# EasyEDA Pro project 定时喝水PCB.eprj, board PCB1
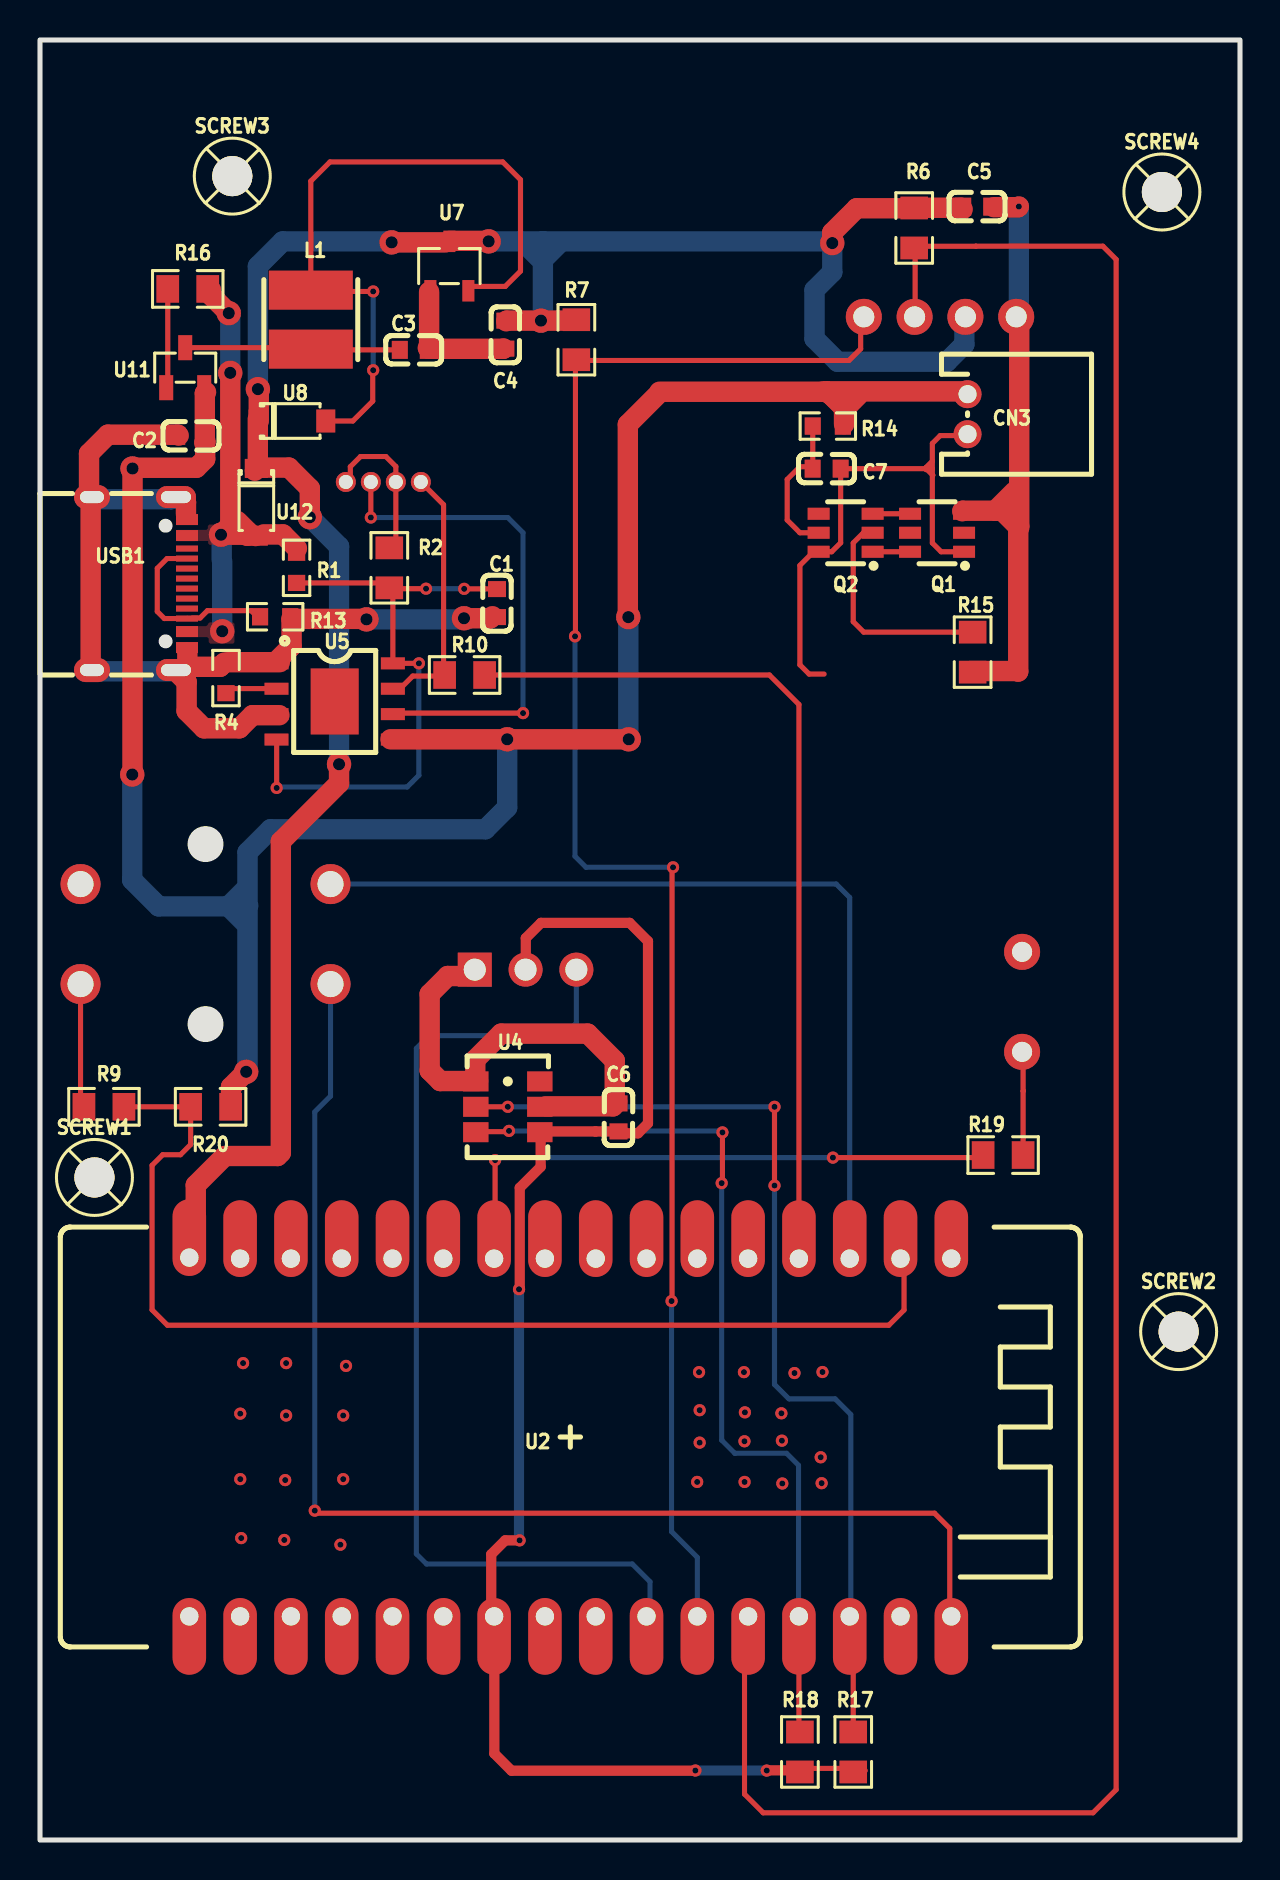
[diagram p2: board, top side]
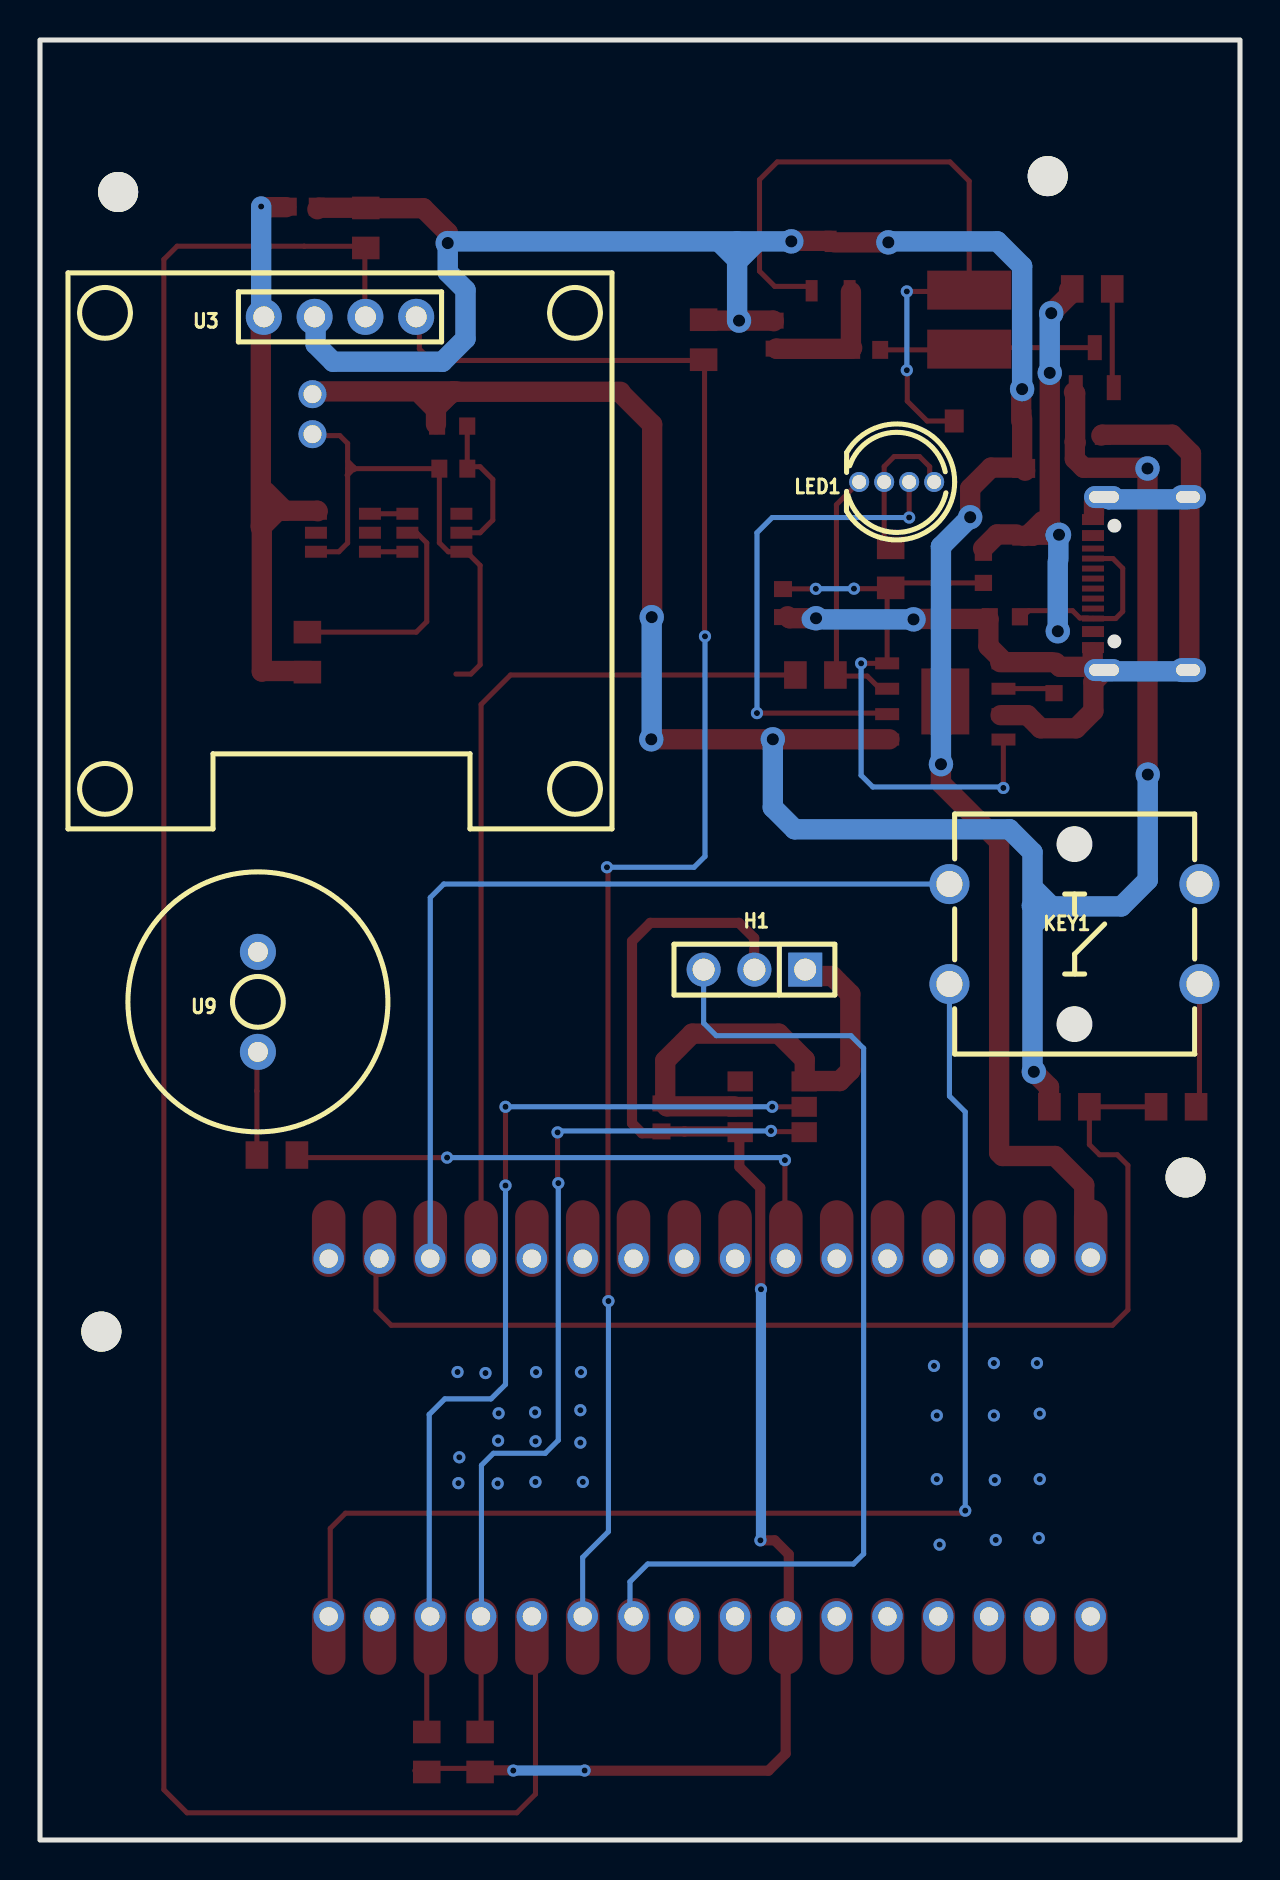
[diagram p3: board, bottom side, seen from below]

Outline 60 x 90 mm; copper layers: Top Layer, Bottom Layer. Coordinates in mm from the lower left corner of the outline.
Outline path: rectangle 0,90 60,0
Stack: Top Layer 0.035mm / Dielectric1 1.51mm FR4 er 4.5 / Bottom Layer 0.035mm

## Design rules (mm)
template: JLCPCB Capability(Two Layers Board)
spacing copperThickness1oz (default): track to track 0.102, other pairs 0.152 to 0.3
spacing copperThickness2oz: track to track 0.203, other pairs 0.152 to 0.3
track width copperThickness1oz (default): min 0.127, default 0.254, max 2.54
track width copperThickness2oz: min 0.203, default 0.254, max 2.54
differential pair differentialPair (default): width min 0.127, default 0.254, max 2.54; gap min 0.152, default 0.152
via viaSize (default): diameter min 0.5, default 0.61, max 10; hole min 0.3, default 0.305, max 6.3

## Placement (name value [footprint] x y rotation side)
C1  10uF  [C0603]  22.85 61.85 90 top
C2  10uF  [C0603]  7.56 70.2 0 top
C3  10uF  [C0603]  18.69 74.51 0 top
C4  22uF  [C0603]  23.27 75.27 90 top
C5  100nF  [C0603]  46.86 81.67 0 top
C6  100nF  [C0603]  28.92 36.13 90 top
C7  100nF  [C0603]  39.33 68.57 0 top
CN3  PH-2AWDK  [CONN-TH_PH-2AWDK]  46.38 71.29 90 top
H1  PZ254V-11-03P  [HDR-TH_3P-P2.54-V-M]  24.28 43.52 0 bottom
KEY1  B3F-4055  [KEY-TH_4P-L12.0-W12.0-P5.00-LS13.4-EH]  8.28 45.3 180 bottom
L1  47uH  [IND-SMD_L4.5-W4.0_GCD43-XX]  13.54 76.02 90 top
LED1  XL-B504RGBC  [LED-TH_4P-BD5.8-P1.25]  17.17 67.9 0 bottom
Q1  FS8205A  [SOT-23-6_L2.9-W1.6-P0.95-LS2.8-BR]  44.85 65.36 0 top
Q2  DW01  [SOT-23-6_L2.9-W1.6-P0.95-LS2.8-BR]  40.28 65.36 0 top
R1  400mΩ  [R0603]  12.83 63.61 270 top
R2  1kΩ  [R0805]  17.47 63.61 90 top
R4  1.2kΩ  [R0603]  9.3 58.1 90 top
R6  4.7kΩ  [R0805]  43.71 80.6 90 top
R7  4.7kΩ  [R0805]  26.82 75.01 90 top
R9  10kΩ  [R0805]  3.2 36.66 180 top
R10  10kΩ  [R0805]  21.23 58.25 0 top
R13  5.1kΩ  [R0603]  11.76 61.16 180 top
R14  100Ω  [R0603]  39.39 70.7 180 top
R15  1kΩ  [R0805]  46.63 59.39 90 top
R16  10kΩ  [R0805]  7.39 77.55 180 top
R17  4.7kΩ  [R0805]  40.66 4.4 270 top
R18  4.7kΩ  [R0805]  37.99 4.4 90 top
R19  1kΩ  [R0805]  48.15 34.25 0 top
R20  10kΩ  [R0805]  8.53 36.66 180 top
SCREW1  -  [M2螺丝]  2.72 33.13 0 top
SCREW2  -  [M2螺丝]  56.93 25.42 0 top
SCREW3  -  [M2螺丝]  9.61 83.19 0 top
SCREW4  -  [M2螺丝]  56.09 82.4 0 top
U2  ESP32C3-合宙  [esp32c3-合宙]  26.53 20.15 270 top
U3  HS96L03W2C03  [OLED-TH_L27.8-W27.2-P2.54_C9900033791]  45 76.16 180 bottom
U4  AHT10  [SENSOR-SMD_AHT10]  23.39 36.66 270 top
U5  TP4056  [ESOP-8_L4.9-W3.9-P1.27-LS6.0-BL-EP]  14.73 56.93 270 top
U7  QX2303L50T  [SOT-23-3_L2.9-W1.6-P1.90-LS2.8-BR]  20.47 78.7 270 top
U8  SD103AW  [SOD-123_L2.8-W1.8-LS3.7-RD]  12.6 70.95 0 top
U9  4kHz  [BUZ-TH_BD12.5-P5.00-D0.9]  49.11 41.91 270 bottom
U11  KY2301H  [SOT-23-3_L2.9-W1.3-P1.90-LS2.4]  7.26 73.62 270 top
U12  SD103AW  [SOD-123_L2.8-W1.8-LS3.7-RD]  10.82 66.89 270 top
USB1  TYPE-C 16PIN 2MD(073)  [USB-C-SMD_TYPE-C-6PIN-2MD-073]  4.97 62.82 270 top

## Footprints (pads in the part's own frame, mm; a bottom-side part is the same pattern mirrored in y, then rotated)
BUZ-TH_BD12.5-P5.00-D0.9
  round 1.8 hole 1: 1(-2.5,0) 2(2.5,0)
C0603
  rect 0.8x0.9 smd: 1(-0.7,0) 2(0.7,0)
CONN-TH_PH-2AWDK
  round 1.4 hole 0.9: 1(-1,0) 2(1,0)
ESOP-8_L4.9-W3.9-P1.27-LS6.0-BL-EP
  rect 0.6x1.2 smd: 1(-1.905,-2.909) 2(-0.635,-2.909) 3(0.635,-2.909) 4(1.905,-2.909) 5(1.905,2.909) 6(0.635,2.909) 7(-0.635,2.909) 8(-1.905,2.909)
  rect 3.3x2.4 smd: 9(0,0)
esp32c3-合宙
  oval 3.836x1.677 smd: 1(-9.918,19.038) 2(-9.918,16.498) 3(-9.918,13.958) 4(-9.918,11.418) 5(-9.918,8.878) 6(-9.918,6.338) 7(-9.918,3.798) 8(-9.918,1.258) 9(-9.918,-1.282) 10(-9.918,-3.822) 11(-9.918,-6.362) 12(-9.918,-8.902) 13(-9.918,-11.442) 14(-9.918,-13.982) 15(-9.918,-16.522) 16(-9.97,-19.062) 17(9.97,19.038) 18(9.97,16.498) 19(9.97,13.958) 20(9.97,11.418) 21(9.97,8.878) 22(9.97,6.338) 23(9.97,3.798) 24(9.97,1.258) 25(9.97,-1.282) 26(9.97,-3.822) 27(9.97,-6.35) 28(9.97,-8.902) 29(9.97,-11.442) 30(9.97,-13.982) 31(9.97,-16.522) 32(9.97,-19.062)
  round 1.524 hole 0.914: 1(-8.918,19.038) 2(-8.918,16.498) 3(-8.918,13.958) 4(-8.918,11.418) 5(-8.918,8.878) 6(-8.918,6.338) 7(-8.918,3.798) 8(-8.918,1.258) 9(-8.918,-1.282) 10(-8.918,-3.822) 11(-8.918,-6.362) 12(-8.918,-8.902) 13(-8.918,-11.442) 14(-8.918,-13.982) 15(-8.918,-16.522) 16(-8.97,-19.062) 17(8.97,19.038) 18(8.97,16.498) 19(8.97,13.958) 20(8.97,11.418) 21(8.97,8.878) 22(8.97,6.338) 23(8.97,3.798) 24(8.97,1.258) 25(8.97,-1.282) 26(8.97,-3.822) 27(8.97,-6.362) 28(8.97,-8.902) 29(8.97,-11.442) 30(8.97,-13.982) 31(8.97,-16.522) 32(8.97,-19.062)
HDR-TH_3P-P2.54-V-M
  rect 1.7x1.7 hole 1.1: 1(-2.54,0)
  round 1.7 hole 1.1: 2(0,0) 3(2.54,0)
IND-SMD_L4.5-W4.0_GCD43-XX
  rect 1.95x4.2 smd: 1(-1.475,0) 2(1.475,0)
KEY-TH_4P-L12.0-W12.0-P5.00-LS13.4-EH
  round 2 hole 1.3: 1(6.25,-2.5) 2(-6.25,-2.5) 3(6.25,2.5) 4(-6.25,2.5)
LED-TH_4P-BD5.8-P1.25
  round 1 hole 0.7: 1(0.625,0) 2(1.875,0) 3(-0.625,0) 4(-1.875,0)
M2螺丝
  round 2 hole 2: 1(0,0)
OLED-TH_L27.8-W27.2-P2.54_C9900033791
  round 1.8 hole 1.05: 1(-3.81,0) 2(-1.27,0) 3(1.27,0) 4(3.81,0)
R0603
  rect 0.806x0.864 smd: 1(-0.753,0) 2(0.753,0)
R0805
  rect 1.133x1.377 smd: 1(-1,0) 2(1,0)
SENSOR-SMD_AHT10
  rect 1x1.27 smd: 1(-1.27,-1.6) 2(0,-1.6) 3(1.27,-1.6) 4(1.27,1.6) 5(0,1.6) 6(-1.27,1.6)
SOD-123_L2.8-W1.8-LS3.7-RD
  rect 0.95x1.15 smd: 1(-1.692,0) 2(1.692,0)
SOT-23-3_L2.9-W1.3-P1.90-LS2.4
  rect 1.25x0.7 smd: 1(1,-0.95) 2(1,0.95) 3(-1,0)
SOT-23-3_L2.9-W1.6-P1.90-LS2.8-BR
  rect 1.07x0.6 smd: 1(1.235,-0.95) 2(1.235,0.95) 3(-1.235,0)
SOT-23-6_L2.9-W1.6-P0.95-LS2.8-BR
  rect 1.1x0.6 smd: 1(1.35,-0.95) 2(1.35,0) 3(1.35,0.95) 4(-1.35,0.95) 5(-1.35,0) 6(-1.35,-0.95)
USB-C-SMD_TYPE-C-6PIN-2MD-073
  rect 0.55x1.1 smd: 1(-3.2,2.375) 2(-2.4,2.375) 11(2.4,2.375) 12(3.2,2.375)
  rect 0.3x1.1 smd: 3(-1.75,2.375) 4(-1.25,2.375) 5(-0.75,2.375) 6(-0.25,2.375) 7(0.25,2.375) 8(0.75,2.375) 9(1.25,2.375) 10(1.75,2.375)
  oval 1.1x2 hole 0.6x1.5: 13(-4.325,1.825) 14(4.325,1.825)
  oval 1.2x1.8 hole 0.6x1.2: 13(-4.325,-2.375) 14(4.325,-2.375)

## Nets
As in the schematic, except:
GND: C1.1 C2.1 C3.2 C4.1 C5.2 C6.2 H1.1 Q1.3 R4.2 R13.1 R15.1 U3.1 U4.1 U4.5 U5.1 U5.3 U7.1 U9.1 USB1.1 USB1.12 USB1.13 USB1.14
AHT_SCL: R17.1 U2.19 U4.2
AHT_SDA: R18.2 U2.20 U4.3

Pads without a net: KEY1 3; Q1 2 5; Q2 4; SCREW1 1; SCREW2 1; SCREW3 1; SCREW4 1; U2 1 5 6 7 8 9 11 12 13 14 15 18 24 25 27 28 29 30 31 32; U4 6; U5 9; USB1 3 5 6 7 8 9

## Via types
v1: diameter 1.219, hole 0.61, Top Layer to Bottom Layer, 19 vias
v2: diameter 0.61, hole 0.305, Top Layer to Bottom Layer, 52 vias

## Routing (per net, layer and track width the routed paths; a pad name or vN(x,y) marks a point on that pad's centre or on a via; arc(x,y) is an arc through that point)
+3.3V: length 73.1
  Top Layer w0.254: 41.26,3.47 41.15,3.58 38.07,3.58
  Top Layer w0.508: 22.9,9.77 22.72,9.58 22.72,4.32 23.57,3.47 32.76,3.47 v2(32.77,3.47) ; 22.56,11.25 22.56,14.28 23.26,14.98 v2(23.98,14.98) ; 24.05,43.57 24.29,43.81 24.29,45.1 25.05,45.86 29.48,45.86 30.4,44.94 30.4,35.84 29.9,35.33 29.29,35.33 29.19,35.44 ; v2(23.95,27.54) 23.99,27.57 23.99,32.61 25.03,33.66 25.03,35.41 ; 25.06,35.39 25.1,35.43 27.77,35.43 ; 28.98,35.32 28.87,35.43 27.77,35.43 ; 36.37,3.47 36.36,3.48 ; 27.77,35.43 27.77,35.42 ; 36.32,3.48 38.03,3.48
  Bottom Layer w0.508: v2(36.34,3.47) 36.33,3.47 v2(32.77,3.47) ; v2(23.98,14.98) 23.95,15.01 v2(23.95,27.54)
+5V: length 22.1
  Top Layer w1.016: 9.87,65.94 10.4,65.41 10.4,65.21 ; v1(9.51,73.36) 9.51,65.72 v1(9.05,65.26) 10.29,65.26 10.34,65.21 ; 12.85,64.58 12.15,65.28 11.18,65.28 ; v1(9.11,60.44) 9.06,60.39 ; v1(9.44,76.34) 8.54,77.24 8.54,77.51 ; 10.76,65.22 10.78,65.2
  Bottom Layer w1.016: v1(9.51,73.36) 9.51,76.27 v1(9.44,76.34) ; 9.08,64.02 9.08,65.23 ; 9.08,65.23 9.21,65.23 9.21,65.28 ; 9.08,65.23 v1(9.05,65.26) ; v1(9.11,60.44) 9.11,63.92
+VCC: length 115.2
  Top Layer w1.016: 26.46,75.97 26.46,75.97 v1(25.05,75.97) 23.34,75.97 23.31,75.94 ; 10.89,71.05 10.89,68.62 ; 10.89,68.62 12.45,68.62 13.49,67.58 v1(13.49,66.14) ; 10.89,68.62 10.89,68.61 10.74,68.46 ; 43.77,81.61 46.06,81.61 46.13,81.54 ; v1(14.95,53.79) 14.95,52.84 12.04,49.93 12.04,34.37 11.87,34.2 9.24,34.2 7.79,32.74 7.79,31.12 ; v1(39.61,79.85) 39.61,80.37 40.83,81.59 43.62,81.59 ; v1(22.43,79.93) 22.41,79.96 20.49,79.96 ; v1(17.58,79.88) 20.27,79.88 ; 10.94,70.95 10.94,72.25
  Bottom Layer w1.016: 25.14,79.93 v1(22.43,79.93) ; 25.14,79.93 39.53,79.93 v1(39.61,79.85) 39.61,78.39 38.73,77.5 38.73,75.06 39.88,73.91 45.35,73.91 46.22,74.78 46.22,76.03 ; 25.14,79.93 25.14,79.01 ; v1(17.58,79.88) 17.53,79.93 12.14,79.93 10.89,78.69 v1(10.89,72.54) ; 25.14,79.01 25.91,79.77 ; 25.14,79.01 25.14,76.06 v1(25.05,75.97) ; v1(13.49,66.14) 14.95,64.68 v1(14.95,53.79) ; 24.93,79.13 24.21,79.85
GND: length 113.6
  Top Layer w1.016: 25.29,36.68 28.65,36.68 28.77,36.8 ; 48.86,66.64 48.91,66.59 48.91,65.66 ; 48.73,76.5 48.96,76.27 48.96,65.71 48.91,65.66 ; 7.36,58.66 7.21,58.51 ; 7.36,58.66 9.01,58.66 9.22,58.87 ; 7.36,58.66 7.3,58.66 ; 7.36,58.66 7.37,58.67 7.37,59.37 ; 6.93,70.22 6.89,70.27 3.39,70.27 2.45,69.32 2.45,67.4 2.36,67.31 ; 12.58,61 12.58,59.69 11.89,59 ; 21.76,37.98 21.76,39.02 23.06,40.32 27.39,40.32 28.74,38.97 28.74,37.03 28.86,36.91 ; 47.76,66.46 48.11,66.46 48.91,65.66 ; 47.76,66.46 46.14,66.46 46.11,66.44 ; 47.76,66.46 48.71,67.41 ; 11.97,56.24 10.63,56.24 9.97,55.59 8.2,55.59 7.33,56.45 7.33,57.9 6.9,58.34 ; v1(16.32,61.03) 16.3,61.05 12.57,61.05 ; 48.91,65.66 48.96,65.61 ; 48.91,65.66 48.91,58.42 48.88,58.45 46.49,58.45 ; 19.39,74.61 19.45,74.67 19.45,77.41 ; 7.3,66.29 7.3,66.88 6.99,67.19 ; 19.42,74.56 23.17,74.56 23.18,74.58 ; 2.56,58.43 2.53,58.47 2.53,67.03 2.52,67.04 ; 47.69,81.64 48.91,81.64 v2(48.94,81.67) ; 21.9,37.95 20.01,37.95 19.48,38.48 19.48,42.3 20.39,43.2 21.44,43.2 21.77,43.53 ; 9.42,58.89 11.99,58.89 ; v1(21.2,61.09) 22.52,61.09 22.62,61.19
  Bottom Layer w1.016: 21.41,61.04 21.25,61.04 v1(21.2,61.09) ; 6.85,58.47 6.82,58.43 2.56,58.43 ; 48.88,76.15 48.94,76.22 v2(48.94,81.67) ; 6.65,67.13 6.55,67.04 2.63,67.04 ; v1(16.32,61.03) 20.86,61.03
  vias: v2(10.01,21.32) v2(10.01,18.04) v2(10.06,15.09) v2(10.15,23.84) v2(12.26,18) v2(12.21,15) v2(12.31,23.84) v2(12.31,21.22) v2(15.02,14.77) v2(15.16,21.22) v2(15.16,18.04) v2(15.3,23.7) v2(32.86,17.9) v2(32.95,23.39) v2(32.98,21.49) v2(32.98,19.87) v2(35.2,23.39) v2(35.24,21.38) v2(35.22,19.94) v2(35.23,17.9) v2(37.07,21.33) v2(37.1,19.97) v2(37.12,17.83) v2(37.72,23.35) v2(39.03,19.14) v2(39.12,23.4) v2(39.08,17.84)
AHT_SCL: length 48.3
  Top Layer w0.254: v2(36.73,32.72) v2(36.73,36.66) ; R17.1 40.66,10 U2.19 ; U4.2 v2(23.39,36.66)
  Bottom Layer w0.254: v2(36.73,36.66) v2(23.39,36.66) ; 40.46,11.13 40.54,11.2 40.54,21.28 39.76,22.05 37.45,22.05 36.73,22.78 v2(36.73,32.72)
AHT_SDA: length 45.2
  Top Layer w0.254: v2(34.08,32.84) 34.12,32.88 v2(34.12,35.38) ; U2.20 37.95,5.45 R18.2 ; v2(23.45,35.45) 23.41,35.42 21.88,35.42
  Bottom Layer w0.254: v2(34.12,35.38) 34.05,35.45 v2(23.45,35.45) ; v2(34.08,32.84) 34.08,19.99 34.74,19.34 37.33,19.34 37.93,18.73 37.93,11.39
BAT+: length 116.5
  Top Layer w1.016: v1(4.61,53.27) 4.63,53.29 v1(4.63,68.58) 4.66,68.61 7.82,68.61 8.26,69.05 8.26,69.9 ; 39.26,72.41 39.39,72.41 ; 39.26,72.41 39.37,72.41 ; 39.26,72.41 30.97,72.41 ; 39.39,72.41 39.41,72.39 39.39,72.41 ; 8.26,69.9 8.24,69.92 8.24,72.33 8.3,72.39 ; 8.26,69.9 8.21,69.86 ; 8.26,69.9 8.26,69.99 ; 39.41,72.36 39.44,72.36 ; 39.44,72.36 39.91,71.92 ; 39.44,72.36 39.41,72.39 ; 39.44,72.36 39.5,72.31 ; 39.5,72.31 40.2,71.6 40.2,71.52 ; 39.5,72.31 39.46,72.31 ; 40.2,71.52 40.19,71.51 ; 40.2,71.52 40.2,70.79 ; 40.2,71.52 40.89,72.21 ; v1(10.31,38.41) 9.55,37.65 9.55,36.66 ; 29.41,61.07 29.39,61.09 29.39,70.78 30.97,72.36 ; 17.53,55.04 v1(23.36,55.04) v1(29.44,55.04) ; 46.33,72.4 46.3,72.43 39.16,72.43
  Bottom Layer w1.016: 9.42,46.68 10.28,45.82 ; 9.42,46.68 5.93,46.68 4.61,48 v1(4.61,53.27) ; 9.42,46.68 10.28,47.54 ; 9.42,46.68 10.37,46.68 ; 10.41,46.71 10.38,46.68 10.37,46.68 ; v1(29.44,55.04) 29.41,55.06 v1(29.41,61.14) ; v1(10.31,38.41) 10.37,38.47 10.37,46.68 ; v1(23.36,55.04) 23.36,51.62 22.27,50.54 11.53,50.54 10.37,49.38 10.37,46.68
CHARGING: length 13
  Top Layer w0.254: U5.7 18,57.56 18.64,58.2 20.18,58.2 ; 20.18,58.2 R10.1 ; 20.18,58.2 20.18,66.77 LED1.2
IO_BUZZ: length 5.2
  Top Layer w0.254: 49.12,39.45 49.15,39.42 49.15,37.45 ; 49.15,37.45 R19.2 ; 49.15,37.45 49.17,37.46
IO_SR602: length 50.5
  Bottom Layer w0.254: U2.23 30.5,11.36 30.5,12.91 29.61,13.8 19.33,13.8 18.82,14.31 18.82,39.58 19.45,40.22 26.18,40.22 26.82,40.85 H1.3
OLED_SCL: length 117.2
  Top Layer w0.254: 43.76,75.96 43.76,79.28 43.58,79.46 ; 44.01,79.69 46.79,79.69 46.79,79.69 53.14,79.69 53.81,79.03 53.81,2.52 52.65,1.36 36.16,1.36 35.23,2.29 35.23,9.46 35.52,9.75
OLED_SDA: length 84
  Top Layer w0.254: 31.6,48.64 31.6,27.02 31.53,26.95 ; 41.17,76.05 41.03,75.92 41.03,74.56 40.45,73.98 26.97,73.98 ; v2(26.75,60.18) 26.77,60.2 26.77,73.95
  Bottom Layer w0.254: 32.92,11 32.87,11.05 32.87,14.13 31.58,15.42 v2(31.58,26.95) ; v2(31.65,48.64) 27.3,48.64 26.75,49.18 v2(26.75,60.18)
$1N2086: length 25.3
  Top Layer w0.254: U5.6 17.7,56.34 v2(24.15,56.34) ; LED1.3 v2(16.54,66.12)
  Bottom Layer w0.254: v2(24.15,56.34) 24.15,65.36 23.39,66.12 v2(16.54,66.12)
$1N2169: length 2.5
  Top Layer w0.254: 9.3,57.57 11.82,57.57 U5.2
$1N2994: length 7.7
  Top Layer w0.254: R2.2 17.79,64.93 LED1.1 17.79,68.67 17.29,69.17 16.02,69.17 15.52,68.66 15.52,68.13 LED1.4
$1N2995: length 30.4
  Top Layer w0.254: 17.64,62.56 U5.8 v2(18.95,58.83) ; 17.64,62.56 v2(19.3,62.56) ; 17.64,62.56 17.62,62.56 17.61,62.55 ; R2.1 17.22,62.85 R1.2 ; U5.4 11.83,55.02 v2(11.83,52.6) ; v2(21.21,62.56) 22.75,62.56 22.79,62.52
  Bottom Layer w0.254: v2(11.83,52.6) 11.88,52.65 18.36,52.65 18.95,53.24 v2(18.95,58.83) ; v2(19.3,62.56) 21.2,62.56 21.21,62.56
$1N3520: length 35.7
  Top Layer w0.254: v2(16.66,73.49) 16.64,73.47 16.64,71.94 15.64,70.95 U8.2 ; v2(16.66,77.43) 13.61,77.43 L1.2 13.54,82.94 14.5,83.9 23.14,83.9 24.02,83.01 24.02,78.44 23.26,77.68 21.64,77.68 U7.2
  Bottom Layer w0.254: v2(16.66,77.43) v2(16.66,73.49)
$1N9123: length 9
  Top Layer w0.254: 7.36,61.08 USB1.10 6.22,61.07 5.86,61.42 5.86,63.58 6.35,64.07 USB1.4 ; 10.83,61.19 10.56,61.47 8.37,61.47 8.01,61.1 7.62,61.1
$1N9611: length 2
  Top Layer w0.254: 41.5,66.31 Q1.4
$1N9631: length 2
  Top Layer w0.254: Q1.6 41.5,64.41
$1N9833: length 11.3
  Top Layer w0.254: Q2.2 41.17,65.36 40.66,64.85 40.66,60.92 41.19,60.39 R15.2
$1N10240: length 5
  Top Layer w0.254: U11.1 6.39,72.69 R16.2
$1N10297: length 10.8
  Top Layer w0.254: C3.1 13.58,74.51 L1.1 13.47,74.62 U11.3
$1N10551: length 63.2
  Top Layer w0.254: v2(13.74,16.47) 13.86,16.34 44.73,16.34 45.49,15.58 45.49,11.26 45.57,11.18
  Bottom Layer w0.254: KEY1.2 14.53,37.19 13.74,36.41 v2(13.74,16.47)
$1N10631: length 56.7
  Top Layer w0.254: U2.2 43.2,29.89 43.2,26.5 42.44,25.74 6.37,25.74 5.6,26.51 5.6,33.73 6.13,34.26 7.02,34.26 7.53,34.77 R20.2 R9.1
$1N10634: length 6.2
  Top Layer w0.254: R9.2 2.03,36.83 KEY1.1
$1N10700: length 44.3
  Bottom Layer w0.254: KEY1.4 39.81,47.8 40.49,47.12 U2.3
$1N12015: length 43
  Top Layer w0.254: U2.4 37.95,56.77 36.47,58.25 R10.2
$1N12092: length 28.5
  Top Layer w0.254: v2(22.76,33.99) 22.76,30.12 U2.10 ; v2(39.65,34.12) 47.03,34.12 R19.1
  Bottom Layer w0.254: v2(22.76,33.99) 22.88,34.12 v2(39.65,34.12)
$1N12145: length 26.9
  Top Layer w0.254: 44.62,68.57 44.62,68.26 ; 44.62,68.57 44.31,68.57 44.62,68.26 ; 44.62,68.57 44.62,68.94 ; 44.62,68.26 44.64,68.24 44.64,68.24 ; 44.62,68.26 44.62,64.85 45.06,64.41 Q1.1 ; 44.3,68.57 C7.2 40.03,64.86 39.58,64.41 38.68,64.41 37.99,63.73 37.99,58.76 38.46,58.3 39.2,58.3 ; 44.3,68.57 44.3,68.51 ; 44.3,68.57 44.3,68.63 44.62,68.94 ; 44.62,68.94 44.62,69.83 45.01,70.22 46.05,70.22 46.31,70.48
$1N12201: length 7.4
  Top Layer w0.254: R14.2 38.64,68.57 C7.1 38.54,68.66 37.99,68.66 37.36,68.03 37.36,66 37.99,65.36 38.8,65.36

## Copper pours and planes (outline as drawn; the poured copper is in the pictures)
+5V on Top Layer: 6.81,65.77 9.67,65.77 9.67,64.76 6.81,64.76
+5V on Top Layer: 6.8,60.88 9.72,60.88 9.72,59.82 6.8,59.82
GND on Top Layer: -2.27,93.44 63.78,93.44 63.78,-4.32 -2.27,-4.32

Small or netless copper shapes (teardrops, artwork), in the pictures only: 1 on Top Layer
